# EasyEDA Pro project URADORRY-SUN1.2.eprj, board Sub - ATmega32U4(1.2)
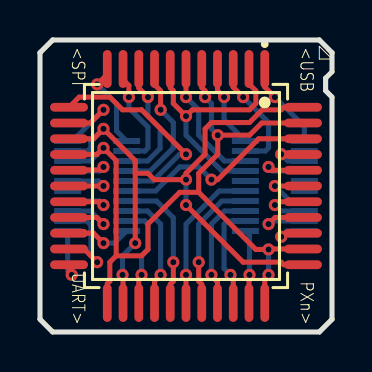
[diagram p9: board, top side]
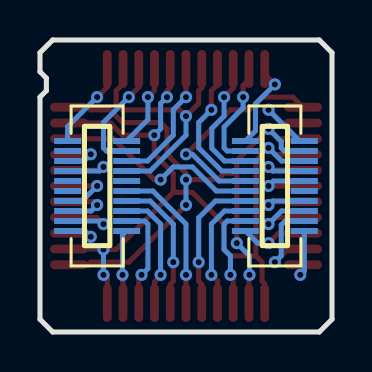
[diagram p10: board, bottom side, seen from below]

Outline 14.61 x 14.6 mm; copper layers: Top Layer, Bottom Layer. Coordinates in mm from the lower left corner of the outline.
Outline path: 0,13.97 0.64,14.6 13.97,14.6 14.61,13.97 14.61,13.02 14.29,12.7 14.29,12.06 14.61,11.75 14.61,0.63 13.97,0 0.64,0 0,0.64 0,13.97
Stack: Top Layer 0.035mm - / Dielectric1 0.71mm FR4 er 4.5 / Bottom Layer 0.035mm -

## Design rules (mm)
template: JLCPCB Capability(Two Layers Board)
spacing copperThickness1oz (default): track to track 0.102, other pairs 0.152 to 0.3
spacing copperThickness2oz: track to track 0.203, other pairs 0.152 to 0.3
track width copperThickness1oz (default): min 0.127, default 0.254, max 2.54
track width copperThickness2oz: min 0.203, default 0.254, max 2.54
differential pair differentialPair (default): width min 0.127, default 0.254, max 2.54; gap min 0.152, default 0.152
via viaSize (default): diameter min 0.5, default 0.61, max 10; hole min 0.3, default 0.305, max 6.3

## Placement (name value [footprint] x y rotation side)
ATmega32U4  ATMEGA32U4-AU  [QFP-44_L10.0-W10.0-P0.80-LS13.2-BL]  7.3 7.3 180 top
MTAPP(M)/AT  AXK6F20547YG  [CONN-SMD_20P-P0.50_C2917022]  11.75 7.3 270 bottom
MTSYS(M)/AT  AXK6F20547YG  [CONN-SMD_20P-P0.50_C2917022]  2.86 7.3 270 bottom

## Footprints (pads in the part's own frame, mm; a bottom-side part is the same pattern mirrored in y, then rotated)
CONN-SMD_20P-P0.50_C2917022
  rect 0.3x1.35 smd: 1(-2.25,-1.475) 2(-2.25,1.475) 3(-1.75,-1.475) 4(-1.75,1.475) 5(-1.25,-1.475) 6(-1.25,1.475) 7(-0.75,-1.475) 8(-0.75,1.475) 9(-0.25,-1.475) 10(-0.25,1.475) 11(0.25,-1.475) 12(0.25,1.475) 13(0.75,-1.475) 14(0.75,1.475) 15(1.25,-1.475) 16(1.25,1.475) 17(1.75,-1.475) 18(1.75,1.475) 19(2.25,-1.475) 20(2.25,1.475)
QFP-44_L10.0-W10.0-P0.80-LS13.2-BL
  oval 0.441x1.895 smd: 1(-3.937,-5.851) 2(-3.15,-5.851) 3(-2.362,-5.851) 4(-1.575,-5.851) 5(-0.787,-5.851) 6(0,-5.851) 7(0.787,-5.851) 8(1.575,-5.851) 9(2.362,-5.851) 10(3.15,-5.851) 11(3.937,-5.851) 23(3.937,5.851) 24(3.15,5.851) 25(2.362,5.851) 26(1.575,5.851) 27(0.787,5.851) 28(0,5.851) 29(-0.787,5.851) 30(-1.575,5.851) 31(-2.362,5.851) 32(-3.15,5.851) 33(-3.937,5.851)
  oval 1.895x0.441 smd: 12(5.851,-3.937) 13(5.851,-3.15) 14(5.851,-2.362) 15(5.851,-1.575) 16(5.851,-0.787) 17(5.851,0) 18(5.851,0.787) 19(5.851,1.575) 20(5.851,2.362) 21(5.851,3.15) 22(5.851,3.937) 34(-5.851,3.937) 35(-5.851,3.15) 36(-5.851,2.362) 37(-5.851,1.575) 38(-5.851,0.787) 39(-5.851,0) 40(-5.851,-0.787) 41(-5.851,-1.575) 42(-5.851,-2.362) 43(-5.851,-3.15) 44(-5.851,-3.937)

## Nets
As in the schematic.

Pads without a net: MTAPP(M)/AT 3 9 10 11; MTSYS(M)/AT 12

## Via types
v1: diameter 0.61, hole 0.305, Top Layer to Bottom Layer, 43 vias

## Routing (per net, layer and track width the routed paths; a pad name or vN(x,y) marks a point on that pad's centre or on a via; arc(x,y) is an arc through that point)
+3.3V: length 33.3
  Top Layer w0.254: 4.76,7.94 5.4,7.94 5.72,7.62 v1(7.3,7.62) 7.3,7.94 8.25,8.89 8.25,10.16 8.57,10.48 10.48,10.48 11.11,11.11 12.06,11.11 12.19,11.24 ATmega32U4.44 ; 4.76,7.94 v1(4.76,4.44) ; 4.76,7.94 4.76,8.57 v1(3.18,10.16) 2.68,9.66 ATmega32U4.14 ; v1(7.3,6.35) 10.16,3.49 12.06,3.49 12.19,3.37 ATmega32U4.34 ; v1(4.13,2.86) 4.15,2.83 ATmega32U4.24
  Bottom Layer w0.254: v1(4.76,4.44) 4.13,3.81 v1(4.13,2.86) ; v1(3.18,10.16) 2.54,9.52 2.54,9.21 2.39,9.05 MTSYS(M)/AT.4 ; v1(7.3,7.62) v1(7.3,6.35)
+5V: length 13
  Top Layer w0.254: ATmega32U4.2 10.45,12.41 10.8,12.06 10.8,11.43 10.48,11.11 7.62,11.11 v1(7.3,10.8) 6.67,11.43 6.67,12.06 6.52,12.22 ATmega32U4.7
  Bottom Layer w0.254: v1(7.3,10.8) 7.3,9.84 9.09,8.05 MTAPP(M)/AT.8
GND: length 38.9
  Top Layer w0.254: 3.81,3.81 3.49,3.49 3.49,2.54 3.37,2.41 ATmega32U4.23 ; 3.81,3.81 5.08,3.81 5.4,4.13 5.4,5.4 6.99,6.98 7.94,6.98 ; 3.81,3.81 3.81,8.57 v1(3.18,9.21) 2.84,8.88 ATmega32U4.15 ; 7.94,6.98 7.94,7.94 8.89,8.89 v1(8.89,9.84) 10.48,9.84 11.09,10.45 ATmega32U4.43 ; 7.94,6.98 10.8,4.13 v1(11.43,4.13) 11.46,4.15 ATmega32U4.35 ; ATmega32U4.33 11.24,2.67 v1(11.43,2.86) ; ATmega32U4.5 8.09,12.23 8.25,12.06 v1(8.25,11.75)
  Bottom Layer w0.254: v1(3.18,9.21) 2.52,8.55 MTSYS(M)/AT.6 ; v1(11.43,2.86) v1(11.43,4.13) ; v1(8.89,9.84) 8.57,10.16 8.57,11.43 v1(8.25,11.75)
AREF/AT: length 10.4
  Top Layer w0.254: v1(8.57,7.62) 8.89,7.62 10.93,9.66 ATmega32U4.42
  Bottom Layer w0.254: MTSYS(M)/AT.11 5.78,7.05 6.99,8.25 7.94,8.25 v1(8.57,7.62)
CTS/AT: length 2.8
  Top Layer w0.254: ATmega32U4.22 1.45,2.99 v1(1.59,2.86)
  Bottom Layer w0.254: MTSYS(M)/AT.20 1.38,3.06 v1(1.59,2.86)
D+/AT: length 4.2
  Top Layer w0.254: ATmega32U4.4 8.88,12.08 v1(9.21,11.75)
  Bottom Layer w0.254: MTAPP(M)/AT.2 9.21,10.62 v1(9.21,11.75)
D-/AT: length 5.9
  Top Layer w0.254: v1(10.16,11.75) 9.66,12.24 ATmega32U4.3
  Bottom Layer w0.254: MTAPP(M)/AT.4 11.28,9.05 11.43,9.21 11.43,10.48 v1(10.16,11.75)
MISO/AT: length 4.4
  Top Layer w0.254: v1(2.86,12.38) 3.37,12.89 ATmega32U4.11
  Bottom Layer w0.254: v1(2.86,12.38) 3.83,11.41 3.83,10.06 MTSYS(M)/AT.1
MOSI/AT: length 5.6
  Top Layer w0.254: v1(4.45,11.75) 4.45,12.33 4.15,12.62 ATmega32U4.10
  Bottom Layer w0.254: MTSYS(M)/AT.3 5.24,9.05 5.4,9.21 5.4,10.25 4.45,11.21 v1(4.45,11.75)
PB4: length 7.6
  Top Layer w0.254: ATmega32U4.28 v1(7.3,2.86)
  Bottom Layer w0.254: MTAPP(M)/AT.12 8.96,7.05 7.3,5.4 v1(7.3,2.86)
PB5: length 6.8
  Top Layer w0.254: ATmega32U4.29 8.09,2.39 7.94,2.54 v1(7.94,3.49)
  Bottom Layer w0.254: v1(7.94,3.49) 7.94,5.4 9.09,6.55 MTAPP(M)/AT.14
PB6: length 6
  Top Layer w0.254: v1(8.57,2.86) 8.57,2.81 8.88,2.5 ATmega32U4.30
  Bottom Layer w0.254: v1(8.57,2.86) 8.57,5.4 9.23,6.05 MTAPP(M)/AT.16
PC6: length 5.3
  Top Layer w0.254: v1(9.53,2.86) 9.66,2.72 ATmega32U4.31
  Bottom Layer w0.254: v1(9.53,2.86) 9.21,3.17 9.21,5.4 9.36,5.55 MTAPP(M)/AT.18
PC7: length 3.7
  Top Layer w0.254: ATmega32U4.32 10.45,2.57 10.48,2.59 v1(10.48,2.86)
  Bottom Layer w0.254: MTAPP(M)/AT.20 10.48,4.85 v1(10.48,2.86)
PD0: length 3.7
  Top Layer w0.254: ATmega32U4.18 3.01,6.52 v1(3.18,6.35)
  Bottom Layer w0.254: MTSYS(M)/AT.14 2.97,6.55 v1(3.18,6.35)
PD1: length 3.9
  Top Layer w0.254: ATmega32U4.19 2.84,5.73 v1(3.18,5.4)
  Bottom Layer w0.254: v1(3.18,5.4) 2.52,6.05 MTSYS(M)/AT.16
PD4: length 5.3
  Top Layer w0.254: v1(5.08,2.86) 4.94,2.72 ATmega32U4.25
  Bottom Layer w0.254: v1(5.08,2.86) 5.08,3.81 5.4,4.13 5.4,5.4 5.24,5.55 MTSYS(M)/AT.17
PD6: length 6
  Top Layer w0.254: ATmega32U4.26 5.73,2.55 v1(6.03,2.86)
  Bottom Layer w0.254: MTSYS(M)/AT.15 5.38,6.05 6.03,5.4 v1(6.03,2.86)
PD7: length 7
  Top Layer w0.254: v1(6.67,3.49) 6.67,2.54 6.52,2.39 ATmega32U4.27
  Bottom Layer w0.254: MTSYS(M)/AT.13 5.83,6.55 6.67,5.71 v1(6.67,3.49)
PE6: length 4.4
  Top Layer w0.254: ATmega32U4.1 11.24,12.26 v1(11.75,11.75)
  Bottom Layer w0.254: v1(11.75,11.75) 13.22,10.27 MTAPP(M)/AT.1
PF0: length 2.4
  Top Layer w0.254: ATmega32U4.41 12.08,8.88 v1(12.06,8.89)
  Bottom Layer w0.254: v1(12.06,8.89) 12.4,8.55 MTAPP(M)/AT.5
PF1: length 3.7
  Top Layer w0.254: ATmega32U4.40 11.59,8.09 v1(11.43,8.25)
  Bottom Layer w0.254: v1(11.43,8.25) 11.63,8.05 MTAPP(M)/AT.7
PF4: length 3.2
  Top Layer w0.254: ATmega32U4.39 v1(11.75,7.3)
  Bottom Layer w0.254: MTAPP(M)/AT.13 12.5,6.55 v1(11.75,7.3)
PF5: length 3.1
  Top Layer w0.254: v1(11.75,6.35) 11.91,6.52 ATmega32U4.38
  Bottom Layer w0.254: v1(11.75,6.35) 12.05,6.05 MTAPP(M)/AT.15
PF6: length 3.7
  Top Layer w0.254: v1(11.43,5.4) 11.76,5.73 ATmega32U4.37
  Bottom Layer w0.254: MTAPP(M)/AT.17 11.59,5.55 v1(11.43,5.4)
PF7: length 2.4
  Top Layer w0.254: v1(12.06,4.76) 12.24,4.94 ATmega32U4.36
  Bottom Layer w0.254: v1(12.06,4.76) 12.36,5.05 MTAPP(M)/AT.19
RST: length 4.4
  Top Layer w0.254: ATmega32U4.13 2.51,10.45 v1(3.18,11.11)
  Bottom Layer w0.254: v1(3.18,11.11) 1.62,9.55 MTSYS(M)/AT.2
RTS/AT: length 10.8
  Top Layer w0.254: v1(7.3,8.89) 5.08,11.11 4.13,11.11 3.49,11.75 1.96,11.75 ATmega32U4.12
  Bottom Layer w0.254: MTSYS(M)/AT.9 5.65,7.55 6.99,8.89 v1(7.3,8.89)
RXD/AT: length 3.3
  Top Layer w0.254: ATmega32U4.20 2.68,4.94 v1(3.18,4.44)
  Bottom Layer w0.254: MTSYS(M)/AT.19 3.73,4.44 v1(3.18,4.44)
SCLK/AT: length 6.4
  Top Layer w0.254: 4.94,13.15 4.94,12.21 v1(5.4,11.75)
  Bottom Layer w0.254: v1(5.4,11.75) 5.4,10.8 6.01,10.18 6.01,9.19 5.38,8.55 MTSYS(M)/AT.5
SS/AT: length 7.1
  Top Layer w0.254: ATmega32U4.8 5.73,12.37 6.03,12.06 v1(6.03,11.11)
  Bottom Layer w0.254: MTSYS(M)/AT.7 5.51,8.05 6.67,9.21 6.67,10.48 v1(6.03,11.11)
TXD/AT: length 4.9
  Top Layer w0.254: v1(2.86,3.49) 2.2,4.15 ATmega32U4.21
  Bottom Layer w0.254: v1(2.86,3.49) 2.54,3.81 2.54,5.35 2.34,5.55 MTSYS(M)/AT.18
UCAP/AT: length 6.4
  Top Layer w0.254: ATmega32U4.6 v1(7.3,11.75)
  Bottom Layer w0.254: MTAPP(M)/AT.6 9.23,8.55 7.94,9.84 7.94,11.11 v1(7.3,11.75)
XTAL1/AT: length 3.6
  Top Layer w0.254: ATmega32U4.17 v1(3.18,7.3)
  Bottom Layer w0.254: v1(3.18,7.3) 2.93,7.55 MTSYS(M)/AT.10
XTAL2/AT: length 3.7
  Top Layer w0.254: ATmega32U4.16 1.47,8.1 3.02,8.1 v1(3.18,8.25)
  Bottom Layer w0.254: v1(3.18,8.25) 2.97,8.05 MTSYS(M)/AT.8

## Text on the board
Top Silkscreen Layer: <SPI | <USB | UART> | PXn>
